# EasyEDA Pro project kuafu01_030内部老化方案.eprj, board PCB4 (continued)
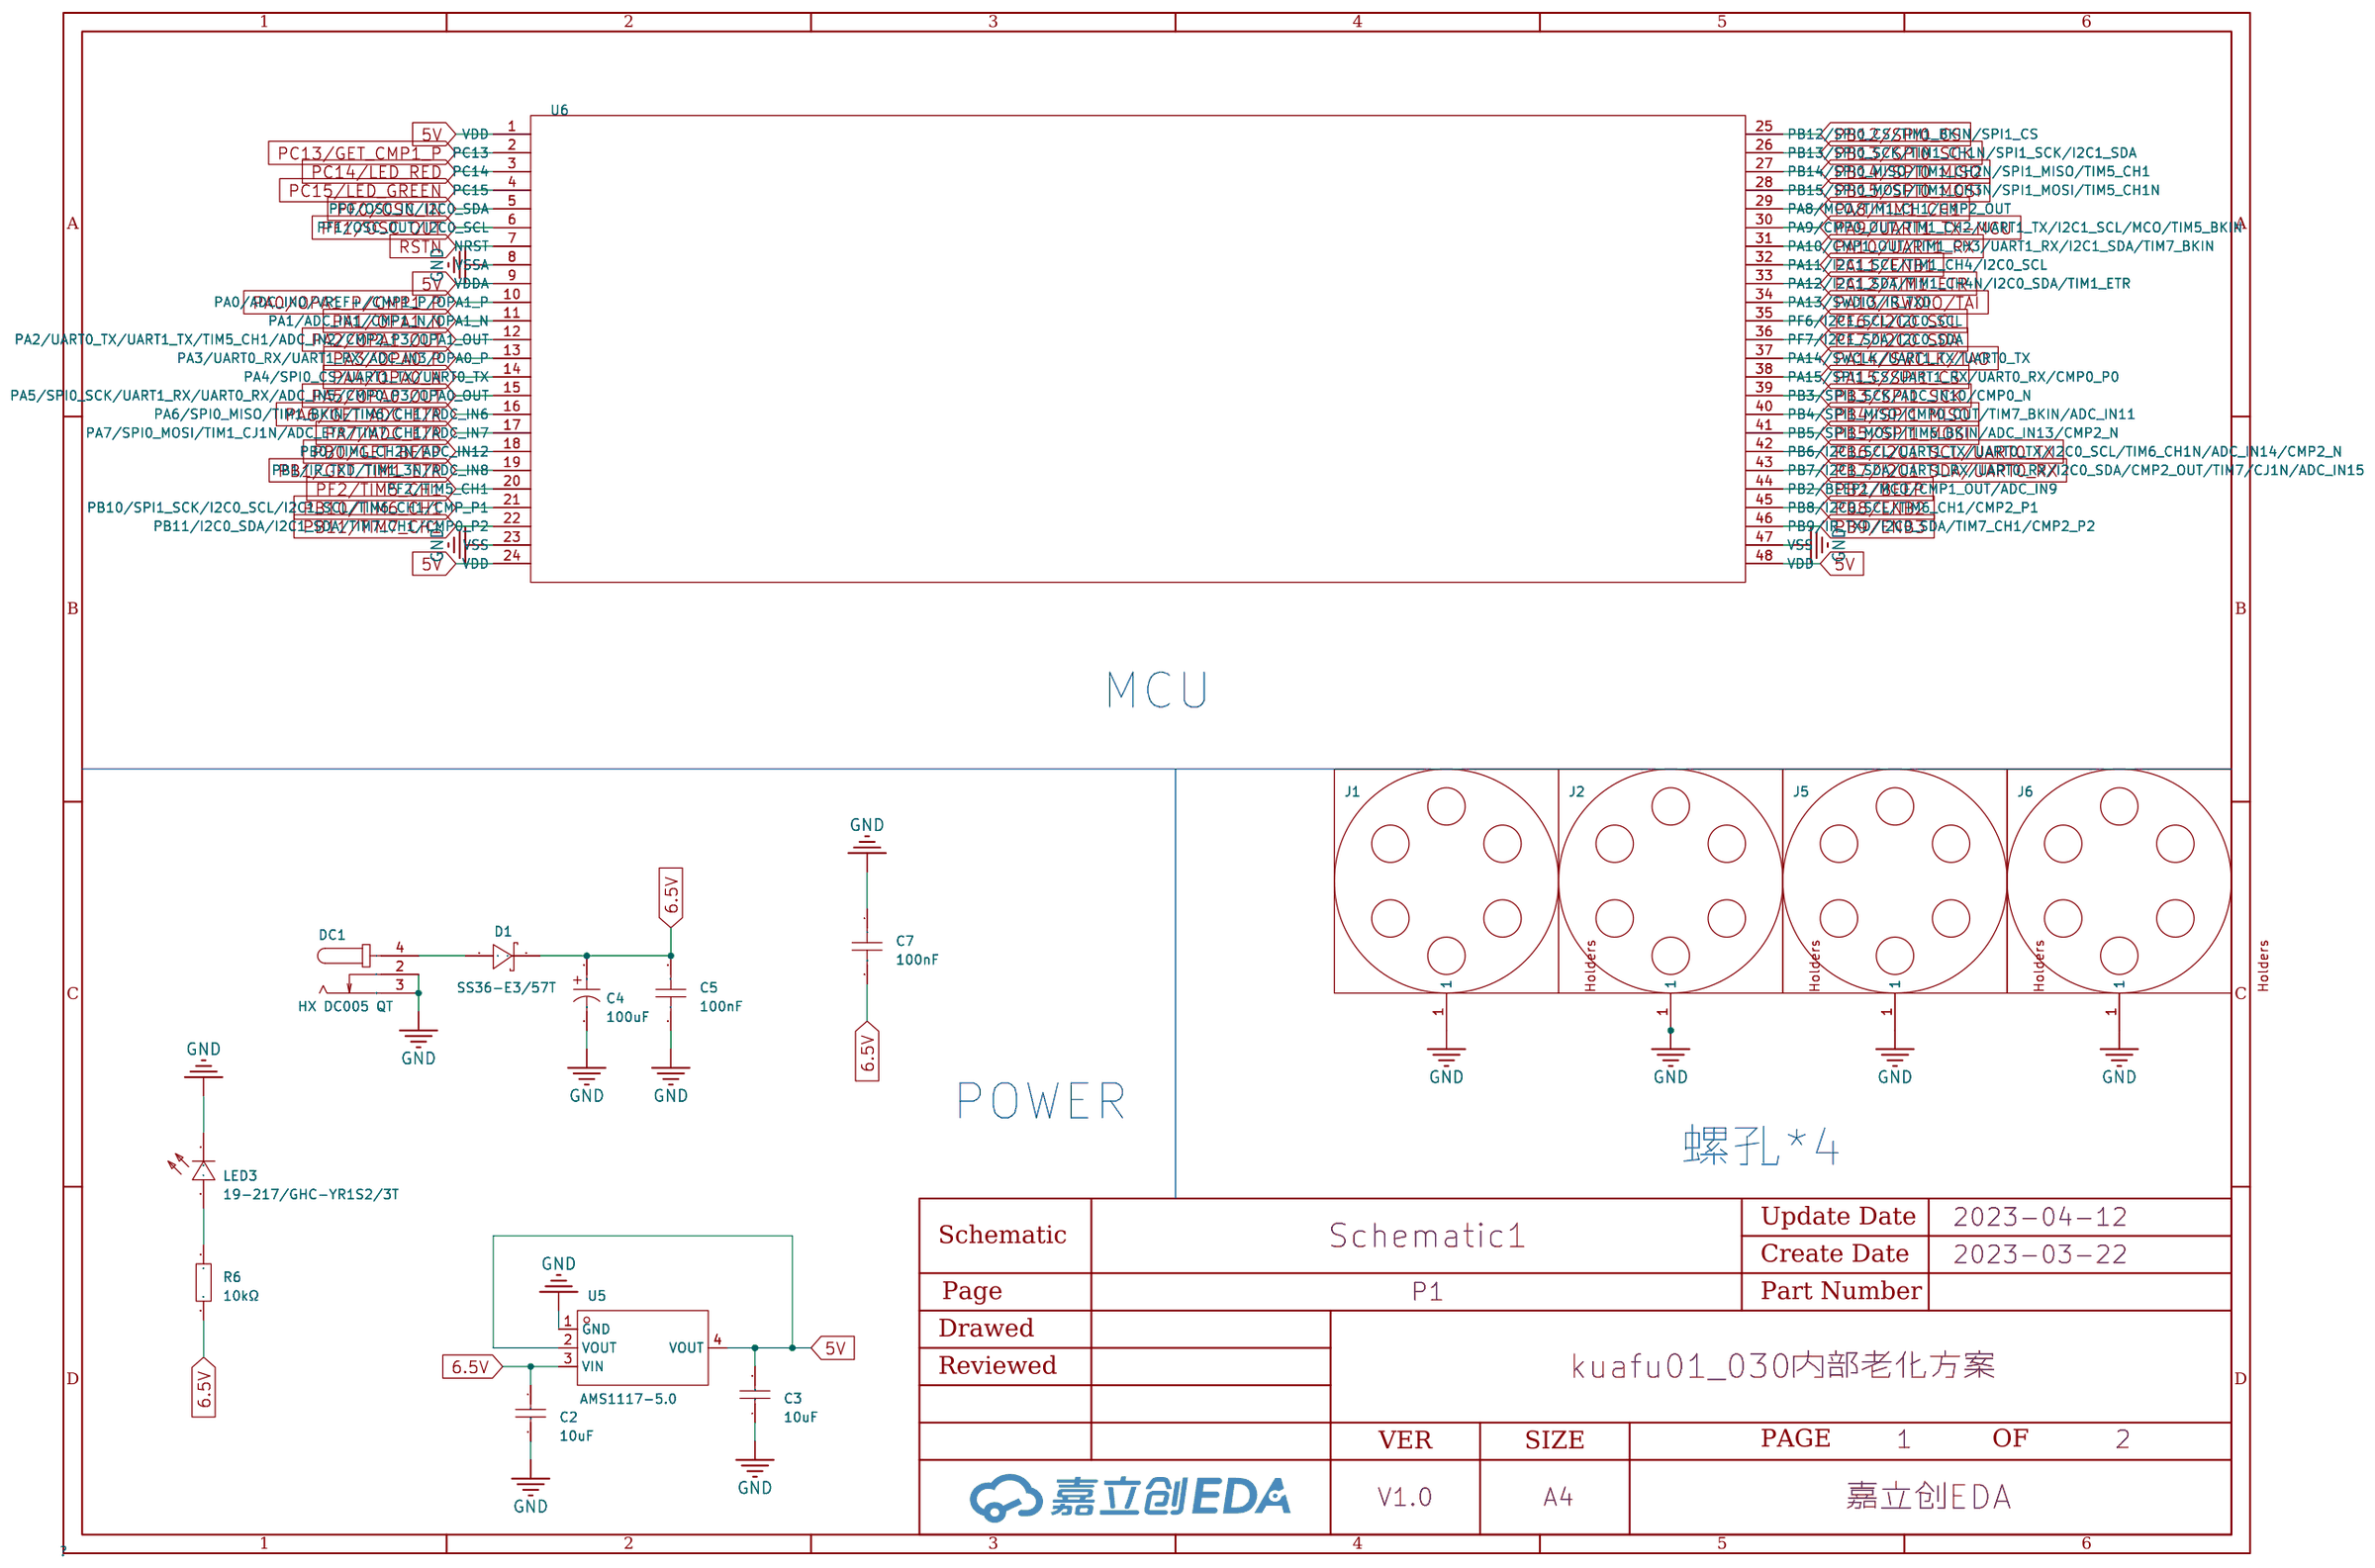
[diagram p0: P1]
## Routing (per net, layer and track width the routed paths; a pad name or vN(x,y) marks a point on that pad's centre or on a via; arc(x,y) is an arc through that point) (continued)
$1N1872: length 3.5
  Top Layer w0.508: D1.1 43.53,353.75 DC1.4
$1N1886: length 2.2
  Top Layer w0.508: 57.38,352.22 57.38,350.07 57.38,350.07
$4N6329: length 117
  Top Layer w0.254: 89.08,134.07 86.18,134.07 86.16,134.08 ; 139.88,235.67 136.98,235.67 136.96,235.69 ; 289.36,337.28 289.38,337.27 292.28,337.27 ; 241.48,83.27 238.58,83.27 238.56,83.28 ; 136.96,337.28 136.98,337.27 139.88,337.27 ; 241.48,134.07 238.58,134.07 238.56,134.08 ; 289.36,184.88 289.38,184.87 292.28,184.87 ; 190.68,286.47 187.78,286.47 187.76,286.49 ; 89.08,32.47 86.18,32.47 86.16,32.49 ; 136.96,83.28 136.98,83.27 139.88,83.27 ; 86.16,235.69 86.18,235.67 89.08,235.67 ; 190.68,32.47 187.78,32.47 187.76,32.49 ; 238.56,235.69 238.58,235.67 241.48,235.67 ; 38.28,83.27 35.38,83.27 35.36,83.28 ; 136.96,134.08 136.98,134.07 139.88,134.07 ; 35.36,235.69 35.38,235.67 38.28,235.67 ; 35.36,286.49 35.38,286.47 38.28,286.47 ; 289.36,235.69 289.38,235.67 292.28,235.67 ; 190.68,83.27 187.78,83.27 187.76,83.28 ; 35.36,184.88 35.38,184.87 38.28,184.87 ; 136.96,32.49 136.98,32.47 139.88,32.47 ; 38.28,134.07 35.38,134.07 35.36,134.08 ; 86.16,83.28 86.18,83.27 89.08,83.27 ; 238.56,337.28 238.58,337.27 241.48,337.27 ; 289.36,286.49 289.38,286.47 292.28,286.47 ; 241.48,286.47 238.58,286.47 238.56,286.49 ; 289.36,83.28 289.38,83.27 292.28,83.27 ; 89.08,337.27 86.18,337.27 86.16,337.28 ; 190.68,134.07 187.78,134.07 187.76,134.08 ; 241.48,32.47 238.58,32.47 238.56,32.49 ; 139.88,286.47 136.98,286.47 136.96,286.49 ; 139.88,184.87 136.98,184.87 136.96,184.88 ; 190.68,184.87 187.78,184.87 187.76,184.88 ; 35.36,32.49 35.38,32.47 38.28,32.47 ; 292.28,134.07 289.38,134.07 289.36,134.08 ; 89.08,184.87 86.18,184.87 86.16,184.88 ; 86.16,286.49 86.18,286.47 89.08,286.47 ; 190.68,337.27 187.78,337.27 187.76,337.28 ; 190.68,235.67 187.78,235.67 187.76,235.69 ; 241.48,184.87 238.58,184.87 238.56,184.88
$4N6330: length 116.1
  Top Layer w0.254: 35.37,237.46 35.39,237.44 38.27,237.44 ; 35.37,85.06 35.39,85.04 38.27,85.04 ; 238.57,237.46 238.59,237.44 241.47,237.44 ; 241.47,135.84 238.59,135.84 238.57,135.86 ; 238.57,34.26 238.59,34.24 241.47,34.24 ; 190.67,288.24 187.79,288.24 187.77,288.26 ; 187.77,34.26 187.79,34.24 190.67,34.24 ; 136.97,237.46 136.99,237.44 139.87,237.44 ; 89.07,339.04 86.19,339.04 86.17,339.06 ; 190.67,186.64 187.79,186.64 187.77,186.66 ; 292.27,135.84 289.39,135.84 289.37,135.86 ; 38.27,34.24 35.39,34.24 35.37,34.26 ; 292.27,85.04 289.39,85.04 289.37,85.06 ; 289.37,339.06 289.39,339.04 292.27,339.04 ; 139.87,186.64 136.99,186.64 136.97,186.66 ; 238.57,288.26 238.59,288.24 241.47,288.24 ; 238.57,85.06 238.59,85.04 241.47,85.04 ; 136.97,339.06 136.99,339.04 139.87,339.04 ; 86.17,237.46 86.19,237.44 89.07,237.44 ; 187.77,339.06 187.79,339.04 190.67,339.04 ; 35.37,135.86 35.39,135.84 38.27,135.84 ; 292.27,186.64 289.39,186.64 289.37,186.66 ; 89.07,135.84 86.19,135.84 86.17,135.86 ; 38.27,288.24 35.39,288.24 35.37,288.26 ; 139.87,288.24 136.99,288.24 136.97,288.26 ; 89.07,186.64 86.19,186.64 86.17,186.66 ; 86.17,288.26 86.19,288.24 89.07,288.24 ; 187.77,237.46 187.79,237.44 190.67,237.44 ; 136.97,34.26 136.99,34.24 139.87,34.24 ; 292.27,288.24 289.39,288.24 289.37,288.26 ; 139.87,85.04 136.99,85.04 136.97,85.06 ; 241.47,186.64 238.59,186.64 238.57,186.66 ; 187.77,135.86 187.79,135.84 190.67,135.84 ; 190.67,85.04 187.79,85.04 187.77,85.06 ; 238.57,339.06 238.59,339.04 241.47,339.04 ; 292.27,237.44 289.39,237.44 289.37,237.46 ; 89.07,34.24 86.19,34.24 86.17,34.26 ; 139.87,135.84 136.99,135.84 136.97,135.86 ; 38.27,186.64 35.39,186.64 35.37,186.66 ; 89.07,85.04 86.19,85.04 86.17,85.06

## Copper pours and planes (outline as drawn; the poured copper is in the pictures)
GND on Bottom Layer: -1.52,381 354.08,381 354.08,0 -1.52,0

## Text on the board
Top Silkscreen Layer: 澎湃微电子
